# EasyEDA Pro project Dart25-有控镖航电系统.eprj, board PCB6
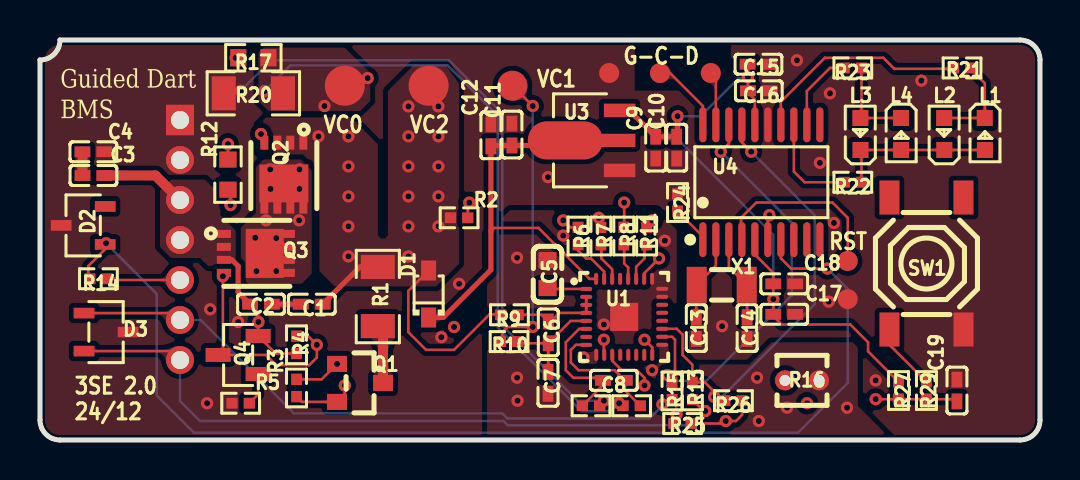
[diagram p10: board, top side]
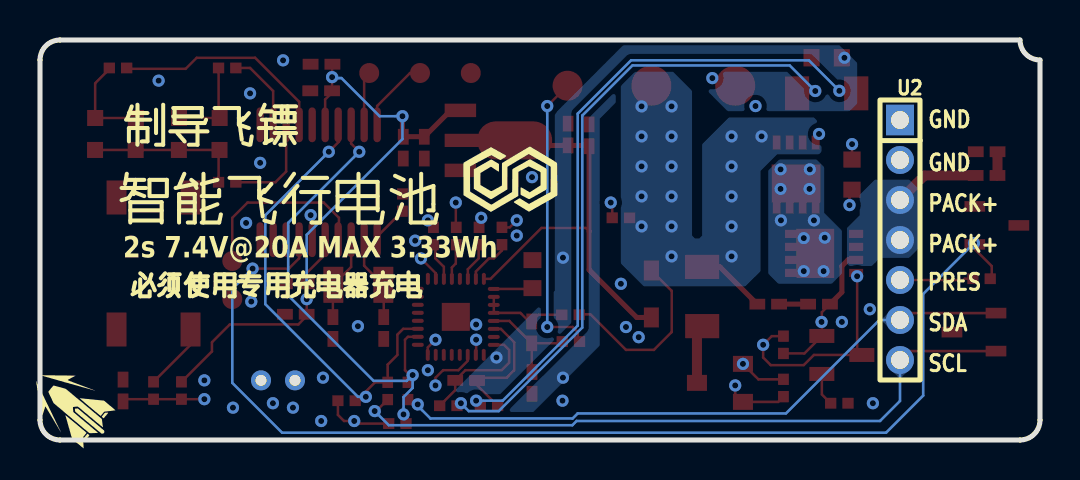
[diagram p11: board, bottom side, seen from below]

Outline 50 x 20 mm; copper layers: Top Layer, Inner1, Inner2, Bottom Layer. Coordinates in mm from the lower left corner of the outline.
Outline path: 0,19 0,1 arc(0.29,0.29) 1,0 49,0 arc(49.71,0.29) 50,1 50,19 arc(49.71,19.71) 49,20 1,20 arc(0.29,19.71) 0,19
Stack: Top Layer 0.035mm 外层铜厚1oz / Dielectric1 0.2104mm 7628 RC49% 8.6mil / Inner1 0.0152mm 内层铜厚 / Dielectric2 1.065mm 1.1mm H/HOZ 含铜 / Inner2 0.0152mm 内层铜厚 / Dielectric3 0.2104mm 7628 RC49% 8.6mil / Bottom Layer 0.035mm 外层铜厚1oz

## Design rules (mm)
template: 自定义配置
spacing copperThickness1oz (default): track to track 0.102, other pairs 0.152 to 0.3
spacing copperThickness2oz: track to track 0.203, other pairs 0.152 to 0.3
track width copperThickness1oz (default): min 0.127, default 0.254, max 2.54
track width copperThickness2oz: min 0.203, default 0.254, max 2.54
differential pair differentialPair (default): width min 0.127, default 0.254, max 2.54; gap min 0.152, default 0.152
via viaSize (default): diameter min 0.5, default 0.61, max 10; hole min 0.3, default 0.305, max 6.3
net GND uses copperRegion1
net AGND uses copperRegion1
net $1N4603 uses copperRegion1
net VC2 uses copperRegion1
net VC0 uses copperRegion1
net PACK+ uses copperRegion1

## Placement (name value [footprint] x y rotation side)
C1  100nF  [C0402]  13.59 6.79 0 top
C2  100nF  [C0402]  11.05 6.79 0 top
C3  100nF  [C0402]  2.67 13.23 0 top
C4  100nF  [C0402]  2.67 14.41 180 top
C5  2.2uF  [C0603]  25.38 8.29 90 top
C6  100nF  [C0402]  25.41 5.38 90 top
C7  100nF  [C0402]  25.4 2.86 90 top
C8  100nF  [C0402]  28.69 2.98 180 top
C9  100nF  [C0402]  30.78 14.62 90 top
C10  1uF  [C0402]  31.83 14.62 90 top
C11  1uF  [C0402]  23.6 15.27 270 top
C12  100nF  [C0402]  22.54 15.23 270 top
C13  22pF  [C0402]  32.82 5.6 90 top
C14  22pF  [C0402]  35.36 5.6 90 top
C15  100nF  [C0402]  35.92 18.79 180 top
C16  1uF  [C0402]  35.94 17.46 180 top
C17  100nF  [C0402]  37.21 6.28 180 top
C18  1uF  [C0402]  37.21 7.81 180 top
C19  100nF  [C0402]  45.85 2.47 270 top
D1  1N5819WS  [SOD-323_L1.8-W1.3-LS2.5-RD]  19.43 7.3 90 top
D2  PSM712-LF-T7  [SOT-23-3_L3.0-W1.7-P0.95-LS2.9-BR]  2.16 10.73 0 top
D3  PSM712-LF-T7  [SOT-23-3_L3.0-W1.7-P0.95-LS2.9-BR]  3.3 5.39 180 top
L1  19-213/Y2C-CQ2R2L/3T(CY)  [LED0603-RD-YELLOW]  47.24 15.3 270 top
L2  19-213/Y2C-CQ2R2L/3T(CY)  [LED0603-RD-YELLOW]  45.21 15.3 90 top
L3  19-213/Y2C-CQ2R2L/3T(CY)  [LED0603-RD-YELLOW]  41.02 15.3 90 top
L4  19-213/Y2C-CQ2R2L/3T(CY)  [LED0603-RD-YELLOW]  43.05 15.3 270 top
NOREF  -  [Pad_e1057]  40.39 8.95 0 top
NOREF#2  -  [Pad_e317]  23.62 17.71 0 top
NOREF#3  -  [Pad_e632]  28.46 18.35 0 top
NOREF#4  -  [Pad_e1058]  40.39 7.05 0 top
NOREF#5  -  [Pad_e309]  19.43 17.71 0 top
NOREF#6  -  [Pad_e618]  31 18.35 0 top
NOREF#7  -  [Pad_e319]  15.24 17.71 0 top
NOREF#8  -  [Pad_e619]  33.54 18.35 0 top
Q1  AO3401A  [SOT-23_L2.9-W1.3-P1.90-LS2.4-BR]  16 2.86 180 top
Q2  CSD17308Q3  [VSON-CLIP-8_L3.3-W3.3-P0.65-BL]  12.19 13.27 180 top
Q3  CSD17308Q3  [VSON-CLIP-8_L3.3-W3.3-P0.65-BL]  10.79 9.33 270 top
Q4  AO3400A  [SOT-23-3_L2.9-W1.3-P1.90-LS2.4-BR]  9.91 4.25 0 top
R1  300Ω  [R1206]  16.89 7.17 270 top
R2  1MΩ  [R0402]  20.96 11.11 180 top
R3  1MΩ  [R0402]  12.83 2.6 90 top
R4  1MΩ  [R0402]  12.83 4.76 270 top
R5  10kΩ  [R0402]  10.03 1.84 0 top
R6  5.1kΩ  [R0402]  26.9 10.2 90 top
R7  5.1kΩ  [R0402]  28.04 10.2 90 top
R8  5.1kΩ  [R0402]  29.19 10.2 90 top
R9  100Ω  [R0402]  23.47 6.26 0 top
R10  100Ω  [R0402]  23.46 4.92 0 top
R11  10kΩ  [R0402]  30.33 10.2 90 top
R12  NCP18XH103F03RB  [R0603]  9.4 13.27 90 top
R13  100Ω  [R0402]  32.62 2.45 90 top
R14  100Ω  [R0402]  2.92 8.06 0 top
R15  100Ω  [R0402]  31.6 2.45 90 top
R16  MF52A103F3950 (A1)  [RES-TH_L2.5-W2.5-P1.70-D0.3]  38.1 2.98 0 top
R17  0Ω  [R0603]  10.67 19.11 0 top
R18  100Ω  [R0402]  29.58 1.71 0 top
R19  100Ω  [R0402]  27.55 1.71 180 top
R20  1mΩ  [R1206]  10.67 17.33 0 top
R21  200Ω  [R0402]  46.1 18.6 0 top
R22  200Ω  [R0402]  40.64 12.89 0 top
R23  200Ω  [R0402]  40.64 18.6 0 top
R24  10kΩ  [R0402]  31.88 11.87 90 top
R25  4.7kΩ  [R0402]  32.13 0.82 0 top
R26  4.7kΩ  [R0402]  34.67 1.97 0 top
R27  10kΩ  [R0402]  42.93 2.47 90 top
R29  510Ω  [R0402]  44.32 2.47 90 top
SW1  TS-1187A-B-A-B  [SW-SMD_4P-L5.1-W5.1-P3.70-LS6.5-TL-2]  44.32 8.82 90 top
U1  BQ40Z50RSMR-R2  [VQFN-32_L4.0-W4.0-P0.40-TL-EP1.4_2]  29.21 6.16 0 top
U2  XDZ200-1-07-Z-2.0-G1  [HDR-TH_7P-P2.00-V-M]  7 10 270 bottom
U3  HT7533-1  [SOT-89-3_L4.5-W2.5-P1.50-LS4.2-BR]  27.62 14.98 0 top
U4  STM32L031F6P6  [TSSOP-20_L6.5-W4.4-P0.65-LS6.4-BL]  36.07 12.89 0 top
X1  32.768kHz  [fc-135r_l3.2-w1.5]  34.09 7.76 180 top

## Footprints (pads in the part's own frame, mm; a bottom-side part is the same pattern mirrored in y, then rotated)
C0402
  rect 0.79x0.54 smd: 1(-0.545,0) 2(0.545,0)
C0603
  rect 0.8x0.9 smd: 1(-0.7,0) 2(0.7,0)
fc-135r_l3.2-w1.5
  rect 1x1.8 smd: 1(-1.25,0) 2(1.25,0)
HDR-TH_7P-P2.00-V-M
  rect 1.524x1.4 hole 0.9: 1(-6,0)
  round 1.4 hole 0.9: 2(-4,0) 3(-2,0) 4(0,0) 5(2,0) 6(4,0) 7(6,0)
LED0603-RD-YELLOW
  rect 0.8x0.8 smd: 1(-0.799,-0.004) 2(0.799,0.004)
Pad_e309
  round 2 smd: 34(0,0)
Pad_e317
  round 1.5 smd: 35(0,0)
Pad_e319
  round 2 smd: 35(0,0)
Pad_e618
  round 1 smd: 36(0,0)
Pad_e619
  round 1 smd: 37(0,0)
Pad_e632
  round 1 smd: 36(0,0)
Pad_e1057
  round 1 smd: 38(0,0)
Pad_e1058
  round 1 smd: 39(0,0)
R0402
  rect 0.566x0.54 smd: 1(-0.433,0) 2(0.433,0)
R0603
  rect 0.806x0.864 smd: 1(-0.753,0) 2(0.753,0)
R1206
  rect 1.208x1.701 smd: 1(-1.479,0) 2(1.479,0)
RES-TH_L2.5-W2.5-P1.70-D0.3
  round 1 hole 0.55: 1(-0.85,0) 2(0.85,0)
SOD-323_L1.8-W1.3-LS2.5-RD
  rect 1x0.75 smd: 1(-1.173,0) 2(1.173,0)
SOT-23-3_L2.9-W1.3-P1.90-LS2.4-BR
  rect 1.25x0.7 smd: 1(1,-0.95) 2(1,0.95) 3(-1,0)
SOT-23-3_L3.0-W1.7-P0.95-LS2.9-BR
  rect 1.038x0.532 smd: 1(1.101,-0.95) 2(1.101,0.95) 3(-1.101,0)
SOT-23_L2.9-W1.3-P1.90-LS2.4-BR
  rect 1x0.8 smd: 1(1.15,-0.95) 2(1.15,0.95) 3(-1.15,0)
SOT-89-3_L4.5-W2.5-P1.50-LS4.2-BR
  rect 1.575x0.672 smd: 1(1.356,-1.5) 3(1.356,1.5)
  custom 5.377x1.9 smd: 2(-1.356,0)
SW-SMD_4P-L5.1-W5.1-P3.70-LS6.5-TL-2
  rect 1.7x1 smd: 1(-3.3,1.85) 2(3.3,1.85) 3(-3.3,-1.85) 4(3.3,-1.85)
TSSOP-20_L6.5-W4.4-P0.65-LS6.4-BL
  oval 0.364x1.742 smd: 1(-2.925,-2.871) 2(-2.275,-2.871) 3(-1.625,-2.871) 4(-0.975,-2.871) 5(-0.325,-2.871) 6(0.325,-2.871) 7(0.975,-2.871) 8(1.625,-2.871) 9(2.275,-2.871) 10(2.925,-2.871) 11(2.925,2.871) 12(2.275,2.871) 13(1.625,2.871) 14(0.975,2.871) 15(0.325,2.871) 16(-0.325,2.871) 17(-0.975,2.871) 18(-1.625,2.871) 19(-2.275,2.871) 20(-2.925,2.871)
VQFN-32_L4.0-W4.0-P0.40-TL-EP1.4_2
  oval 0.6x0.2 smd: 1(-1.9,1.397) 2(-1.9,0.998) 3(-1.9,0.597) 4(-1.9,0.198) 5(-1.9,-0.203) 6(-1.9,-0.602) 7(-1.9,-1.004) 8(-1.9,-1.402) 17(1.9,-1.397) 18(1.9,-0.998) 19(1.9,-0.597) 20(1.9,-0.198) 21(1.9,0.203) 22(1.9,0.602) 23(1.9,1.004) 24(1.9,1.402)
  oval 0.2x0.6 smd: 9(-1.397,-1.9) 10(-0.999,-1.9) 11(-0.597,-1.9) 12(-0.198,-1.9) 13(0.203,-1.9) 14(0.602,-1.9) 15(1.003,-1.9) 16(1.402,-1.9) 25(1.397,1.9) 26(0.998,1.9) 27(0.597,1.9) 28(0.198,1.9) 29(-0.203,1.9) 30(-0.602,1.9) 31(-1.004,1.9) 32(-1.402,1.9)
  rect 1.4x1.4 smd: 33(0,0)
VSON-CLIP-8_L3.3-W3.3-P0.65-BL
  rect 0.4x0.7 smd: 1(-0.975,-1.6) 2(-0.325,-1.6) 3(0.325,-1.6) 4(0.975,-1.6) 5(0.975,1.6) 6(0.325,1.6) 7(-0.325,1.6) 8(-0.975,1.6)
  rect 2.45x1.9 smd: 8(0,0.44)

## Nets
As in the schematic, except:
GND: C4.1 C9.1 C10.1 C11.1 C12.1 C13.1 C14.1 C15.1 C16.1 C17.1 C18.1 C19.1 D2.3 D3.3 NOREF#3.36 NOREF#4.39 R5.1 R19.1 R20.1 R24.2 SW1.3 U2.1 U2.2 U3.1 U4.15
RST: NOREF.38 U4.4
SWCLK: NOREF#6.36 U4.20
SWDIO: NOREF#8.37 U4.19
VC0: NOREF#7.35 R17.2 R18.1 R20.2
VC1: NOREF#2.35 R10.1
VC2: C1.2 D1.2 NOREF#5.34 Q2.1 Q2.2 Q2.3 R1.1 R2.2 R9.1

Pads without a net: D2 2; SW1 2 4; U1 7 12 13 14 15 20 21 22 29; U4 8 9 10 11

## Via types
v1: diameter 0.61, hole 0.305, Top Layer to Bottom Layer, 71 vias
v2: diameter 0.61, hole 0.304, Top Layer to Bottom Layer, 25 vias

## Routing (per net, layer and track width the routed paths; a pad name or vN(x,y) marks a point on that pad's centre or on a via; arc(x,y) is an arc through that point)
AGND: length 0.8
  Top Layer w0.127: v1(9.4,14.79) R12.2
  vias: v1(9.78,19.11) v1(26.16,10.22) v1(27.18,4.12) v1(28.19,5.78) v1(30.61,3.49) v1(31.24,9.97) v2(23.85,9.12) v2(23.85,3.12) v2(23.88,1.97) v2(35.85,3.12) v2(35.94,0.95) v2(37.35,1.62) v2(40.35,1.62)
GND: length 33.3
  Top Layer w0.127: R19.1 28.19,1.92 v1(28.19,1.97) ; R20.1 9.91,17.33 v1(10.03,17.46)
  Bottom Layer w0.127: v1(10.03,17.46) 11.56,18.98 20.45,18.98 23.11,16.32 23.11,5.72 26.87,1.97 v1(28.19,1.97)
  vias: v1(8.36,1.84) v1(8.51,6.54) v1(9.91,5.9) v1(20.07,5.14) v1(20.96,7.81) v1(25.4,13.14) v1(34.1,5.69) v1(37.85,18.98) v1(38.35,1.84) v1(38.99,13.86) v1(39.44,6.92) v1(39.5,17.33) v1(39.7,10.85) v1(41.78,2.98) v1(44.07,17.97)
V3V3: length 45.8
  Top Layer w0.127: C15.2 35.4,18.77 v1(35.4,18.14) 35.4,17.37 35.74,17.02 U4.16 ; 35.74,10.02 35.74,9.28 36.67,8.35 C18.2 v1(36.67,7.04) 36.67,6.19 37.08,5.78 40.51,5.78 41.4,4.89 41.4,4.43 R27.2 ; R26.2 35.1,1.26 34.8,0.95 v1(34.29,0.95) 34.16,0.82 R25.2
  Top Layer w0.254: 28.98,16.48 29.47,16.48 C9.2 31.75,15.16 31.75,15.25 ; 31.75,15.25 31.88,15.37 v1(31.88,16.19) ; 31.75,15.25 31.83,15.16
  Inner1 w0.127: v1(36.67,7.04) 34.29,4.66 v1(34.29,0.95)
  Bottom Layer w0.127: v1(36.67,7.04) 36.67,10.26 31.88,15.05 v1(31.88,16.19) 33.02,16.19 34.93,18.09 35.35,18.09 v1(35.4,18.14)
VBAT: length 20.5
  Top Layer w0.127: 22.54,10.44 22.71,10.6 24.93,10.6 27.47,8.06 U1.32
  Top Layer w0.254: U3.2 26.01,14.73 C11.2 22.58,14.73 C12.2 22.54,8.51 20.16,6.13 D1.1
BOOT0: length 1.9
  Top Layer w0.127: R24.1 33.14,10.17 33.14,10.02
LEDA: length 10.9
  Top Layer w0.127: 45.65,18.56 42.72,18.56 42.16,19.11 39.24,19.11 37.04,16.91 U4.14
LEDB: length 5.1
  Top Layer w0.127: U4.13 37.69,13.42 38.23,12.89 R22.1
LEDC: length 4
  Top Layer w0.127: R23.1 39.5,18.6 38.34,17.45 U4.12
PACK+: length 34.4
  Top Layer w0.127: R11.2 30.61,10.91 v1(30.61,10.98) ; R4.2 11.78,4.33 Q4.2 10.91,6.39 C2.1
  Top Layer w0.254: C2.1 9.91,7.39 9.91,8.7 9.6,9.01 9.19,9.01
  Top Layer w0.5: C3.2 5.77,13.23 U2.3
  Inner1 w0.127: v1(20.7,5.65) 20.7,6.67 20.96,6.92 26.54,6.92 v1(30.61,10.98)
  Inner2 w0.127: v1(20.7,5.65) 20.69,5.66 11.16,5.66 v1(10.92,5.9)
PRES: length 3.7
  Top Layer w0.127: R14.2 3.76,8.06 3.83,8 U2.5
PRES_IN: length 90.2
  Top Layer w0.127: U1.16 30.61,4.63 v1(30.23,5.01) ; v1(39.37,8.57) 37.56,8.57 37.04,9.08 37.04,10.02 ; R14.1 2.41,8.14 2.41,8.7 3.3,9.59 v1(3.3,9.84)
  Inner2 w0.127: v1(3.3,9.84) 3.3,11.36 4.95,13.02 10.03,13.02 13.34,9.71 21.84,9.71 23.24,8.32 26.92,8.32 v1(30.23,5.01)
  Bottom Layer w0.127: v1(39.37,8.57) 40.39,7.55 40.39,2.86 37.89,0.36 7.7,0.36 5.84,2.22 5.84,7.3 v1(3.3,9.84)
RST: length 9.2
  Top Layer w0.127: NOREF.38 40.39,11.11 39.62,11.87 35.81,11.87 35.05,11.11 35.05,10.06 35.09,10.02
SCL: length 35
  Top Layer w0.127: U2.7 6.56,4.44 D3.2 ; 32.62,2.02 33.19,1.45 v1(33.27,1.45)
  Bottom Layer w0.127: U2.7 7,1.95 8,0.95 23.17,0.95 23.38,0.74 32.56,0.74 v1(33.27,1.45)
SCL_IN: length 23.2
  Top Layer w0.127: U1.19 31.84,5.56 32.13,5.27 32.13,4.25 32.62,3.77 R13.2 33.24,2.88 34.16,1.97 R26.1 ; 35.09,15.76 35.05,15.72 35.05,14.92 v1(35.56,14.41)
  Bottom Layer w0.127: v1(33.71,2.16) 34.1,2.16 38.74,6.79 38.74,11.24 v1(35.56,14.41)
SDA: length 31.9
  Top Layer w0.127: v1(31.12,1.78) 31.36,1.78 31.6,2.02 ; U2.6 6.66,6.34 D3.1
  Bottom Layer w0.127: 31.12,1.71 30.48,1.08 23.37,1.08 23.11,1.33 12.7,1.33 8.03,6 U2.6
SDA_IN: length 23.9
  Top Layer w0.127: v1(31.37,3.25) 31.51,3.25 31.75,3.49 31.75,5.01 31.6,5.16 31.11,5.16 ; v1(31.82,1.28) 31.82,0.95 R25.1 ; v1(34.04,14.41) 34.44,14.82 U4.18
  Bottom Layer w0.127: 32,1.42 31.97,1.42 v1(31.82,1.28) 31.82,2.15 31.37,2.6 v1(31.37,3.25) 31.66,2.96 33.32,2.96 37.59,7.23 37.59,10.86 v1(34.04,14.41)
SWCLK: length 3.8
  Top Layer w0.127: NOREF#6.36 31.5,18.35 33.14,16.7 U4.20
SWDIO: length 2.7
  Top Layer w0.127: U4.19 33.79,18.1 NOREF#8.37
VC0: length 32.7
  Top Layer w0.127: R20.2 11.35,17.33 v1(11.24,17.45)
  Bottom Layer w0.127: v1(28.96,1.84) 28.56,1.44 27.06,1.44 22.89,5.62 22.89,16.22 20.38,18.73 ; 20.38,18.73 12.52,18.73 v1(11.24,17.45)
  vias: v1(14.22,16.7) v1(16.38,18.09)
VC1: length 14.6
  Top Layer w0.127: R10.1 23.11,5.01 23.11,5.39 23.37,5.65 v1(24.64,5.65) ; v1(24.64,16.7) NOREF#2.35
  Bottom Layer w0.127: v1(24.64,5.65) v1(24.64,16.7)
VC2: length 12.8
  Top Layer w0.127: R9.1 23.02,6.28 22.48,6.28 20.7,4.51 19.3,4.51 18.41,5.39 18.41,7.46 D1.2
  Top Layer w0.254: R1.1 15.99,8.65 C1.2
  vias: v2(13.92,15.18) v2(15.42,15.18) v2(15.42,13.68) v2(15.42,12.18) v2(15.42,10.68) v2(15.42,9.18) v2(18.42,16.68) v2(18.42,15.18) v2(18.42,13.68) v2(18.42,12.18) v2(18.42,10.68) v2(18.42,9.18) v2(19.92,16.68) v2(19.92,15.18) v2(19.92,13.68) v2(19.92,12.18) v2(19.92,10.68)
$1N357: length 4.5
  Top Layer w0.127: U1.2 U1.3 27.31,6.36 25.98,6.36 25.55,5.93 C6.2 25.08,6.26 R9.2
$1N681: length 1.9
  Top Layer w0.127: U1.1 25.42,7.55 C5.1
$1N857: length 5.4
  Top Layer w0.127: C7.2 25.41,3.41 C6.1 ; C6.1 23.97,4.84 R10.2 ; C6.1 26.53,5.95 U1.5
$1N1609: length 6.5
  Top Layer w0.127: R19.2 28.15,2.74 C8.2 28.02,3.11 26.67,3.11 26.29,3.49 26.29,4.89 26.96,5.56 27.31,5.56
$1N2442: length 29.8
  Top Layer w0.127: R7.2 28.04,11 v1(27.94,11.11) ; v1(14.85,3.81) 14.08,3.03 R3.2
  Inner2 w0.127: v1(27.94,11.11) 27.94,9.71 31.5,6.16 31.5,4.76 31.12,4.38 30.35,4.38 28.57,2.6 26.29,2.6 25.02,1.33 23.37,1.33 20.89,3.81 v1(14.85,3.81)
$1N2863: length 21
  Top Layer w0.127: v1(11.05,15.3) 11.22,15.13 Q2.4 ; R2.1 21.39,11.8 v1(21.46,11.87) ; R6.2 26.51,10.63 v1(26.16,10.98)
  Inner2 w0.127: 23.37,11.87 24.26,10.98 v1(26.16,10.98) ; 23.37,11.87 20.7,14.54 13.34,14.54 12.57,15.3 v1(11.05,15.3) ; 23.37,11.87 v1(21.46,11.87)
$1N2922: length 2.9
  Top Layer w0.5: R1.2 17.15,5.43 Q1.3
$1N3586: length 1.9
  Top Layer w0.127: U1.30 28.61,8.54 28.07,9.08 28.07,9.74 R7.1
$1N3592: length 2.4
  Top Layer w0.127: U1.31 28.21,8.42 27.55,9.08 27.31,9.08 26.9,9.48 R6.1
$1N3598: length 1.8
  Top Layer w0.127: R8.1 29.21,9.74 29.21,8.82 29.41,8.63 U1.28
$1N3944: length 59.1
  Top Layer w0.127: Q3.4 9.19,8.24 v1(9.14,8.19) 9.14,4.49 Q4.3 11.3,4.25 11.81,3.74 13.46,3.74 13.84,4.12 v1(13.84,4.76) 13.41,5.19 12.83,5.19 ; R8.2 29.21,10.65 v1(29.21,11.87)
  Inner2 w0.127: v1(29.21,11.87) 25.02,16.06 9.53,16.06 7.75,17.84 4.83,17.84 1.78,14.79 1.78,8.44 3.05,7.17 4.57,7.17 6.35,8.95 8.38,8.95 v1(9.14,8.19)
$1N4088: length 1.9
  Top Layer w0.127: R11.1 30.23,9.66 30.23,9.08 29.81,8.66 U1.27
$1N4236: length 1.6
  Top Layer w0.127: Q4.1 10.91,2.28 R5.2
$1N4603: length 30.9
  Top Layer w0.127: U1.26 30.21,8.33 v1(30.95,9.08) ; v1(15.24,2.73) 15.24,2.29 Q1.2 13.09,1.91 R3.1
  Inner1 w0.127: v1(11.81,8.44) 12.95,8.44 15.61,5.79 15.61,3.1 v1(15.24,2.73) 18.54,2.73 22.22,6.41 27.18,6.41 29.84,9.08 v1(30.95,9.08)
  vias: v1(10.76,10.11) v1(10.82,8.44) v1(11.3,10.98) v1(11.51,13.53) v1(11.53,12.55) v1(11.81,10.09) v1(12.97,13.53) v1(12.97,12.55) v2(12.95,10.98)
$1N4763: length 26.5
  Top Layer w0.127: v1(9.53,11.75) 9.53,12.39 R12.1 ; v1(28.19,5.01) 28.19,4.27 U1.10
  Inner2 w0.127: v1(9.53,11.75) 9.53,10.09 10.16,9.46 12.57,9.46 15.75,6.28 22.48,6.28 25.53,3.24 28.07,3.24 28.19,3.36 v1(28.19,5.01)
$1N4946: length 10
  Top Layer w0.127: U1.11 28.61,3.96 29.08,3.49 29.84,3.49 30.23,3.11 v1(30.23,2.73)
  Inner2 w0.127: v1(30.23,2.73) 34.8,2.73 35.05,2.47 36.74,2.47 R16.1
$1N5004: length 6.2
  Top Layer w0.127: R18.2 29.24,2.49 29.24,2.98 28.73,3.49 26.92,3.49 26.54,3.87 26.54,4.51 26.8,4.76 27.31,4.76 U1.8
$1N7604: length 1.2
  Top Layer w0.5: C3.1 2.13,14.41 C4.2
$1N7746: length 1.5
  Top Layer w0.254: C2.2 C1.1
$5N1366: length 4.6
  Top Layer w0.127: R23.2 41.07,16.16 L3.2 L4.1
$5N1367: length 7.9
  Top Layer w0.127: L1.2 L2.1 L4.2 L3.1 41.07,14.45 R22.2
$5N1368: length 4.8
  Top Layer w0.127: L2.2 L1.1 47.24,17.83 46.52,18.56
$5N1385: length 4.3
  Top Layer w0.127: 33.79,10.02 33.79,8.72 32.82,7.74 C13.2
$5N1386: length 4.2
  Top Layer w0.127: C14.2 35.36,7.74 34.44,8.65 34.44,10.02
$5N1407: length 3.4
  Top Layer w0.127: R29.2 42.47,4.76 SW1.1
$5N5286: length 16.8
  Top Layer w0.127: v1(36.47,11.24) 36.39,11.17 36.39,10.02 ; v1(41.78,2.04) R27.1 R29.1 45.73,2.04 C19.2
  Inner1 w0.127: v1(36.47,11.24) 37.97,9.74 37.97,5.85 v1(41.78,2.04)

## Copper pours and planes (outline as drawn; the poured copper is in the pictures)
AGND on Top Layer: 40.89,1.71 43.05,-0.45 39.12,-4.38 25.27,-4.38 22.35,-1.46 22.35,10.35 23.5,11.49 30.84,11.49 31.84,10.5 31.84,4.17 32.23,3.77 35.46,3.77 36.58,4.89 40.64,4.89 40.89,4.63
AGND on Bottom Layer: 29.1,0.95 29.58,1.43 29.58,2.14 24.26,7.47 24.26,16.32 20.83,19.75 10.03,19.75 9.14,18.86 9.14,16.83 9.53,16.44 15.62,16.44 17.27,18.09 19.98,18.09 22.01,16.06 22.01,4.72 25.78,0.95
AGND on Inner2: -2.41,22.41 56.01,22.41 56.01,-7.31 -2.41,-7.31
GND on Top Layer: -2.41,22.41 56.01,22.41 56.01,-7.31 -2.41,-7.31
GND on Top Layer: -2.41,22.41 56.01,22.41 56.01,-7.31 -2.41,-7.31
GND on Top Layer: -2.41,22.41 56.01,22.41 56.01,-7.31 -2.41,-7.31
GND on Inner1: -2.41,22.41 56.01,22.41 56.01,-7.31 -2.41,-7.31
PACK+ on Top Layer: 6.54,13.02 8.25,13.02 9.02,12.25 9.02,11.24 9.79,10.47 9.79,8.96 9.53,8.7 8.41,8.7 8,9.11 6.55,9.11 6,9.65 6,12.48
PACK+ on Bottom Layer: 6.54,13.02 8.25,13.02 9.02,12.25 9.02,11.24 9.79,10.47 9.79,8.96 9.53,8.7 8.41,8.7 8,9.11 6.55,9.11 6,9.65 6,12.48
VC0 on Top Layer: 16.51,18.35 16.51,16.95 16,16.44 11.43,16.44 10.92,16.95 10.92,19.36 11.18,19.62 15.24,19.62
VC0 on Inner1: 16.51,18.35 16.51,16.95 16,16.44 12.45,16.44 11.81,17.08 11.81,19.24 12.19,19.62 15.24,19.62
VC2 on Top Layer: 17.25,10.07 17.4,10.22 17.4,17.46 18.69,18.75 20.28,18.75 20.96,17.82 20.96,8.82 19.81,7.68 14.73,7.68 13.97,8.44 13.97,13.46 13.14,14.28 11.05,14.28 10.92,14.41 10.92,15.75 11.3,16.13 15.56,16.13 16.89,14.79 16.89,10.22 17.04,10.07
VC2 on Bottom Layer: 17.25,10.07 17.4,10.22 17.4,17.46 18.69,18.75 20.28,18.75 20.96,17.82 20.96,8.82 19.81,7.68 14.73,7.68 13.97,8.44 13.97,13.46 13.14,14.28 11.05,14.28 10.92,14.41 10.92,15.75 11.3,16.13 15.56,16.13 16.89,14.79 16.89,10.22 17.04,10.07
VC2 on Inner1: 17.25,10.07 17.4,10.22 17.4,17.46 18.69,18.75 20.28,18.75 20.96,17.82 20.96,8.82 19.81,7.68 14.73,7.68 13.97,8.44 13.97,13.46 13.14,14.28 11.05,14.28 10.92,14.41 10.92,15.75 11.3,16.13 15.56,16.13 16.89,14.79 16.89,10.22 17.04,10.07
$1N4603 on Top Layer: 11.18,14.03 10.79,13.65 10.79,11.36 9.91,10.47 9.91,8.32 10.41,7.82 10.41,7.81 13.08,7.81 13.59,8.32 13.59,13.52 13.08,14.03
$1N4603 on Bottom Layer: 11.18,14.03 10.79,13.65 10.79,11.36 9.91,10.47 9.91,8.32 10.41,7.82 10.41,7.81 13.08,7.81 13.59,8.32 13.59,13.52 13.08,14.03
$1N4603 on Inner1: 11.18,14.03 10.79,13.65 10.79,11.36 9.91,10.47 9.91,8.31 10.41,7.81 10.41,7.81 13.08,7.81 13.59,8.31 13.59,13.52 13.08,14.03

Small or netless copper shapes (teardrops, artwork), in the pictures only: 206 on Top Layer, 22 on Bottom Layer, 10 on Inner1, 16 on Inner2

## Text on the board
Bottom Silkscreen Layer: GND | PACK+ | SDA | SCL | PRES | 必须使用专用充电器充电 | 2s 7.4V@20A MAX 3.33Wh | 制导飞镖 | 智能飞行电池
Top Silkscreen Layer: 3SE 2.0 / 24/12 | VC0 | VC2 | VC1 | G-C-D | RST | Guided Dart / BMS
